# EasyEDA Pro project 3SE_24_Power_Rune.eprj, board 深大PCB参考 (continued)
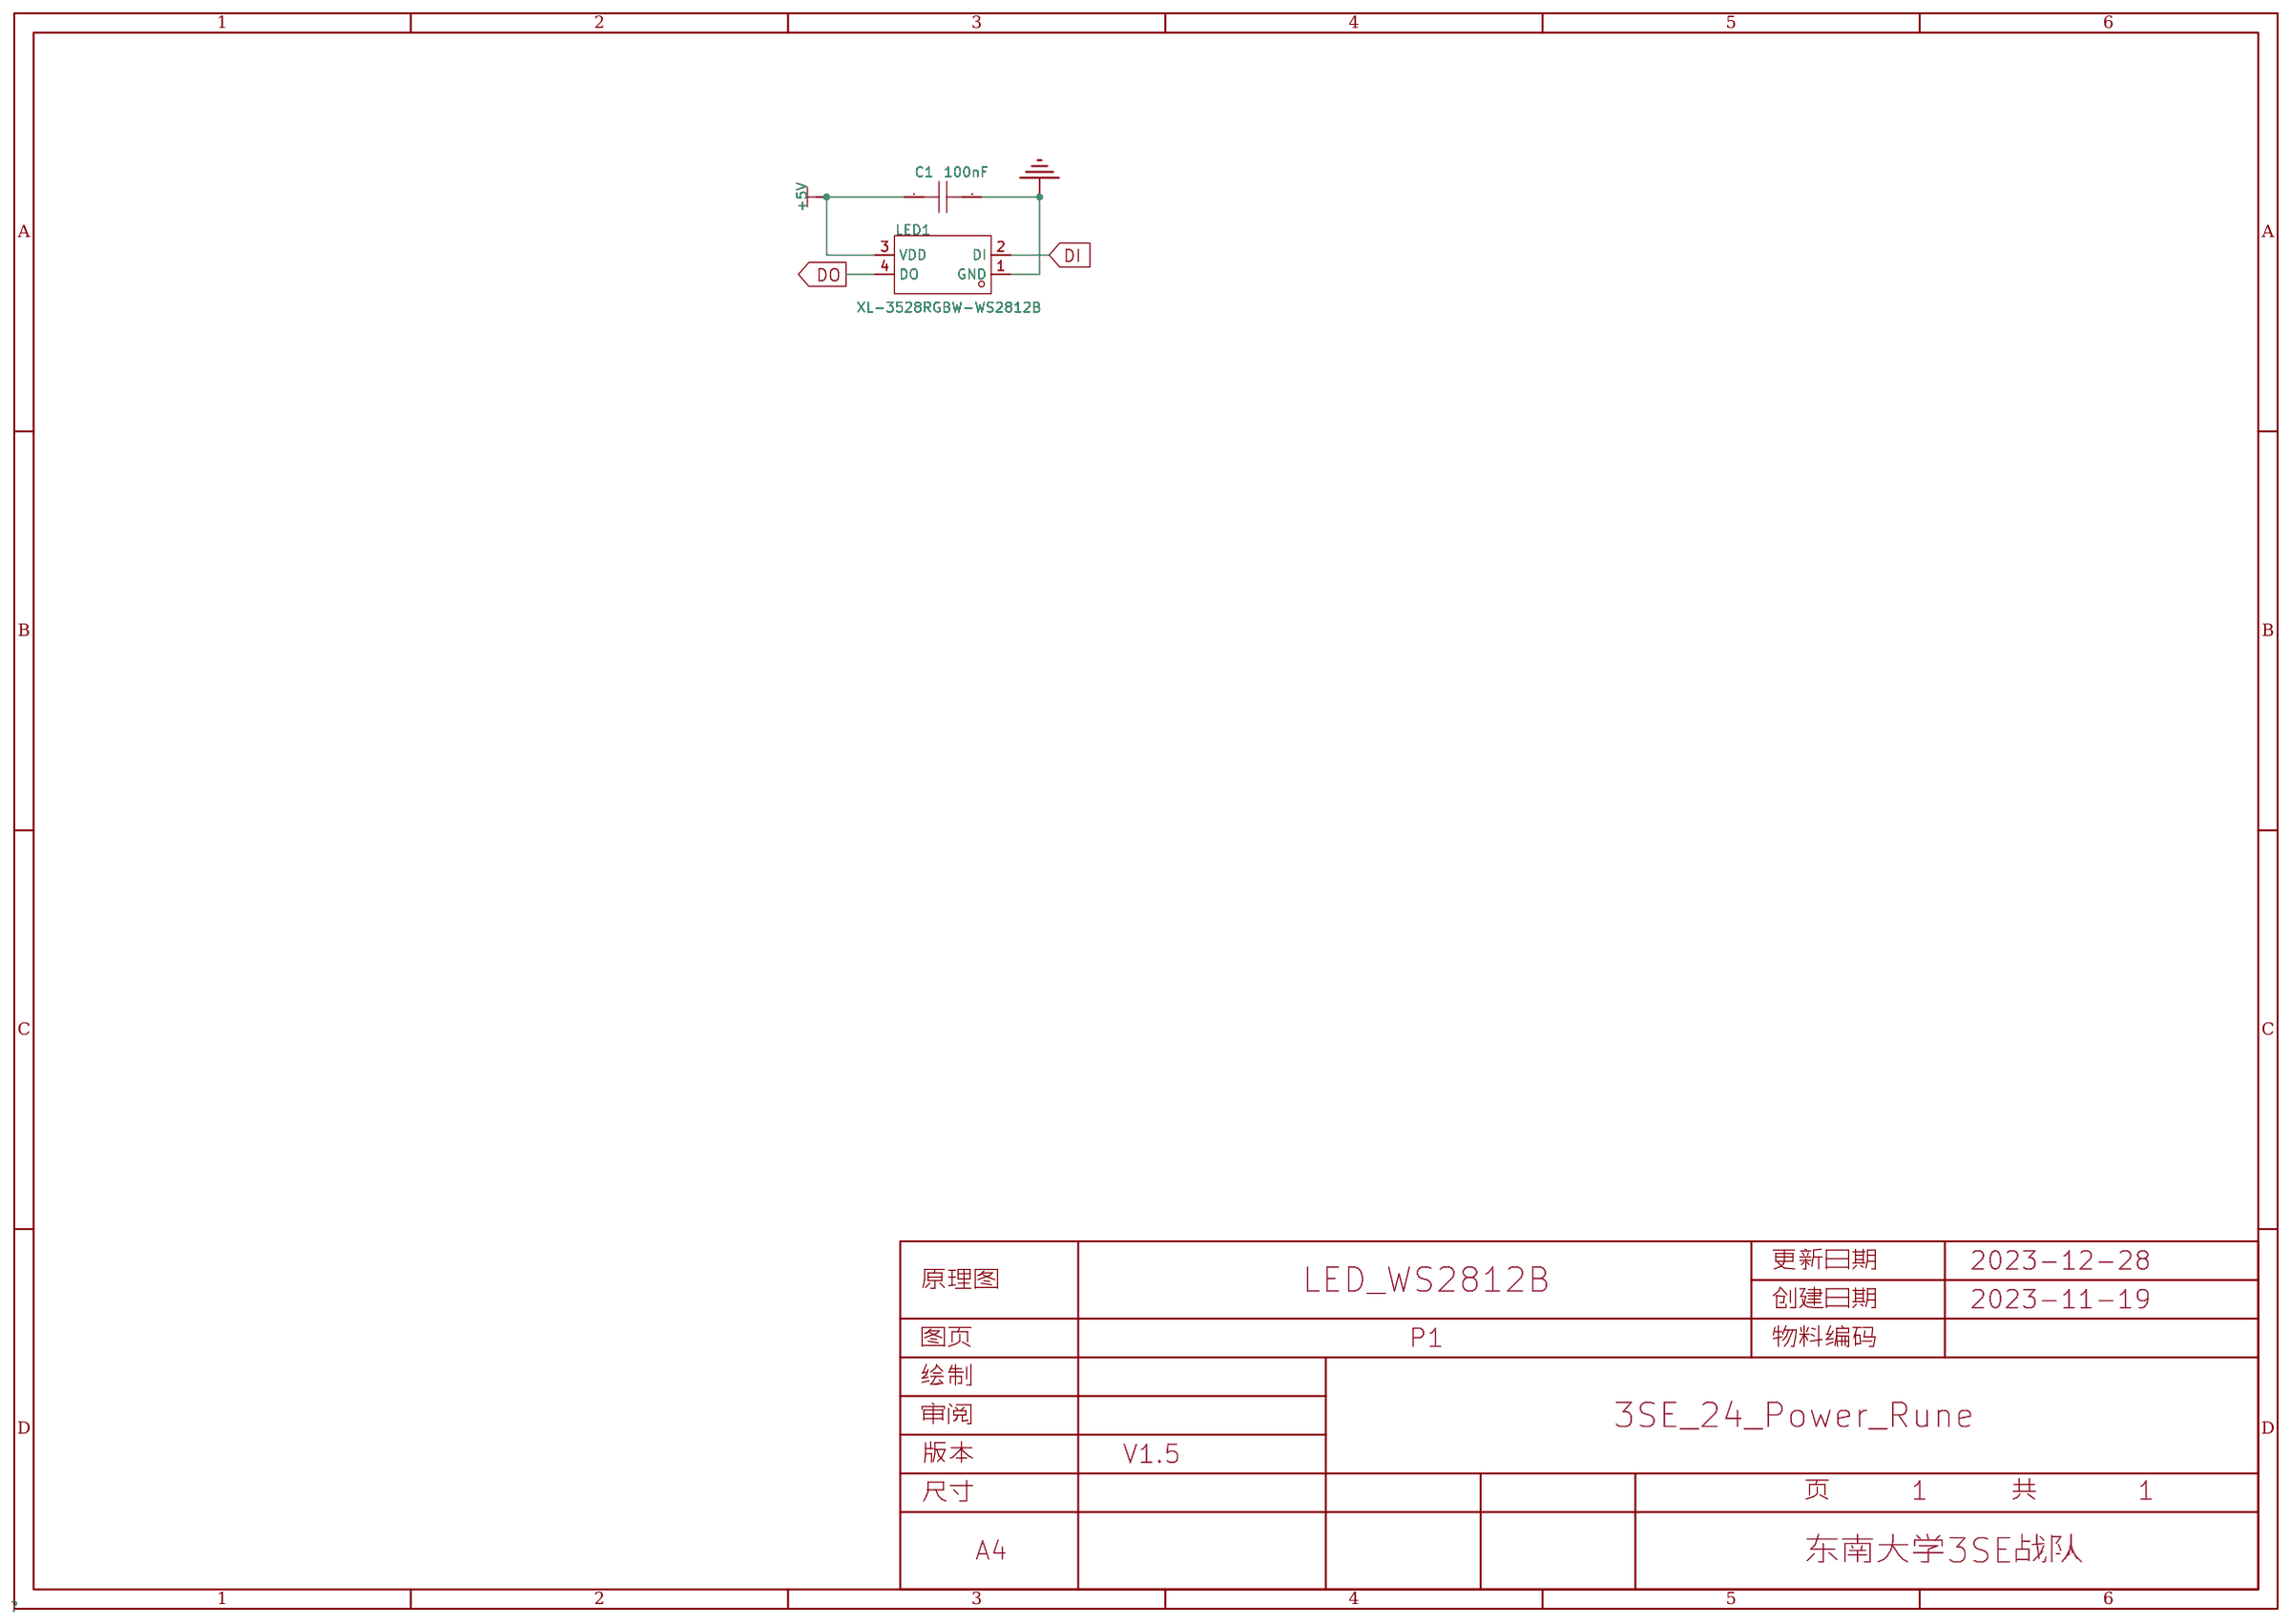
[diagram p0: schematic sheet]
## Routing (per net, layer and track width the routed paths; a pad name or vN(x,y) marks a point on that pad's centre or on a via; arc(x,y) is an arc through that point) (continued)
R_DET6: length 398.6
  Top Layer w0.381: 169.88,255.44 170.22,255.53 171.22,253.45 ; 120.22,177.37 120.31,177.04 123.34,177.65 arc(123.44,177.66) 123.53,177.64 124.01,177.5 124.21,177.13 arc(150.99,139.96) 195.97,131.27 196.48,131.27 arc(197.45,131.08) 198.28,130.53 199.48,129.32 199.48,130.04 arc(199.68,131.01) 200.23,131.83 200.77,132.38 arc(237.03,159.32) 245.43,203.7 arc(245.59,204.48) 246.03,205.14 248.08,207.18 246.64,207.18 arc(245.67,207.38) 244.84,207.93 244.36,208.41 arc(217.33,244.9) 172.7,253.23 171.56,253.24 arc(171.36,253.29) 171.22,253.45
  Bottom Layer w0.381: 169.88,255.44 170.47,254.86 arc(171.01,254.05) J8.1 ; J18.7 338.41,213.51 248.17,206.84 248.08,207.18
R_DET7: length 339.3
  Top Layer w0.381: 175.68,238.64 179.83,238.75 arc(210.55,230.98) 229.24,205.4 231.15,203.48 arc(231.98,202.93) 232.95,202.74 233.47,202.74 231.55,200.81 arc(231,199.99) 230.8,199.02 230.8,197.73 arc(223.68,166.97) 198.61,147.77 196.62,145.78 arc(196.1,145.03) 195.88,144.14 ; 173.18,240.96 173.52,241.05 175.37,238.78 arc(175.51,238.67) 175.68,238.64 ; 135.34,180.68 135.43,180.34 138.98,179.86 arc(139.16,179.79) 139.28,179.63 139.89,178.16 arc(159.84,152.55) 191.67,146.13 192.04,146.13 arc(193.01,145.93) 193.84,145.38 195.88,143.34
  Bottom Layer w0.381: 233.47,202.74 233.56,202.4 298.62,208.99 arc(298.63,208.99) 298.64,208.99 338.41,212.26 J18.8 ; 173.18,240.96 175.8,240.96 arc(175.86,240.95) J7.1
R_DET8: length 287.1
  Top Layer w0.381: 177.25,225.98 178.58,224.65 arc(179.4,224.09) 180.38,223.9 183.77,223.9 arc(201.97,220.09) 213.78,205.72 arc(213.95,204.85) 214.44,204.12 218.36,200.2 216.64,198.48 arc(216.09,197.66) 215.9,196.69 215.9,194.56 arc(211.85,176.53) 197.81,164.49 193.07,159.75 arc(192.52,158.92) 192.32,157.95 192.32,157.94 191.2,159.07 arc(190.37,159.62) 189.4,159.81 186.69,159.81 arc(173.77,162.38) 162.81,169.7 arc(158.26,175.17) 154.78,181.39 152.99,183.17 arc(151.77,183.98) .1
  Bottom Layer w0.381: 329.62,205.34 232.39,193.94 arc(232.29,193.94) 232.19,193.97 ; J18.9 338.41,211.01 332.7,210.58 arc(332.52,210.52) 332.39,210.38 329.91,205.54 arc(329.79,205.4) 329.62,205.34 ; J6.1 179.14,226.82 arc(178.17,226.63) 177.34,226.08 177.25,225.98 ; 232.19,193.97 218.45,199.86 218.36,200.2
R_DET9: length 236.6
  Top Layer w0.381: 163.91,193.25 164,192.91 183.38,169.89 SW5.1 184.05,170.07 192.52,177.22 arc(192.54,177.22) 192.55,177.24 206.79,191.22 SW6.1 206.61,191.9 185.46,214.64 SW3.1
  Bottom Layer w0.381: J18.10 338.41,209.76 334.75,209.69 arc(334.55,209.63) 334.42,209.48 331.18,203.12 arc(331.06,202.98) 330.9,202.92 225.7,186.29 206.79,191.22 SW6.1 ; SW3.1 185.56,214.1 arc(185.93,213.8) 186.35,213.57 arc(186.84,213.41) 187.36,213.36 J5.1
R_DET10: length 187.5
  Top Layer w0.381: 183.01,184.79 182.66,184.79 182.59,184.85 179.31,187.87 arc(179.22,187.98) 179.19,188.12 ; 179.19,188.12 178.71,195.58 arc(178.76,195.79) 178.92,195.94 185.96,199.26 SW1.1
  Bottom Layer w0.381: J4.1 188.75,197.88 arc(187.78,198.07) 186.95,198.62 SW1.1 ; 183.01,184.79 184.23,184.79 190.53,182.39 190.57,182.38 219.32,178.55 219.34,178.55 219.4,178.55 333.16,201.93 333.29,202.06 333.32,202.13 335.96,207.96 arc(336.07,208.11) 336.25,208.18 338.41,208.51 J18.11

## Copper pours and planes (outline as drawn; the poured copper is in the pictures)
GND on Top Layer: 14.99,253.11 27.94,351.92 134.37,381.51 234.82,381.63 340.61,349.38 355.35,247.78 345.44,237.74 346.33,155.32 346.33,154.94 363.35,149.48 369.95,29.72 221.36,0.13 147.7,0.13 0.13,33.15 7.24,146.94 20.83,150.75 21.34,240.54
GND on Bottom Layer: 161.54,281.31 164.72,282.19 164.08,284.86 165.1,285.12 165.48,283.59 167.13,282.83 167.89,282.96 168.7,279.86 162.35,278.21
GND on Bottom Layer: 338.2,207.77 341.5,207.77 341.5,207.01 338.2,207.01
GND on Bottom Layer: 150.88,324.36 154.05,325.25 153.42,327.91 154.43,328.17 154.81,326.64 156.46,325.88 157.23,326.01 158.03,322.91 151.68,321.26
GND on Bottom Layer: 190.63,211.2 189.74,214.38 187.07,213.74 186.82,214.76 188.34,215.14 189.1,216.79 188.98,217.55 192.08,218.36 193.73,212.01
GND on Bottom Layer: 24.48,231.9 24.48,235.3 28.03,235.32 28.03,237.86 29.03,237.86 29.03,236.42 30.27,235.31 31.33,235.31 31.33,231.9
GND on Bottom Layer: 169.04,250.83 172.21,251.71 171.58,254.38 172.59,254.64 172.97,253.11 174.62,252.35 175.39,252.48 176.2,249.38 169.85,247.73
GND on Bottom Layer: 182.5,224.66 181.61,227.84 178.94,227.2 178.69,228.22 180.21,228.6 180.98,230.25 180.85,231.01 183.95,231.82 185.6,225.47
GND on Bottom Layer: 158.24,296.04 161.42,296.93 160.78,299.59 161.8,299.85 162.18,298.32 163.83,297.56 164.59,297.69 165.4,294.59 159.05,292.94
GND on Bottom Layer: 31.33,157.02 31.33,153.63 27.78,153.61 27.78,151.07 26.78,151.07 26.78,152.5 25.54,153.62 24.48,153.62 24.48,157.02
GND on Bottom Layer: 178.18,238.76 177.29,241.94 174.62,241.3 174.37,242.32 175.89,242.7 176.66,244.35 176.53,245.11 179.63,245.92 181.28,239.57
GND on Bottom Layer: 27.94,195.96 31.33,195.96 31.36,192.41 33.9,192.41 33.9,191.4 32.46,191.4 31.35,190.16 31.35,189.1 27.94,189.1
GND on Bottom Layer: 193.93,195.07 190.54,195.07 190.51,198.62 187.97,198.62 187.97,199.63 189.41,199.63 190.52,200.87 190.52,201.93 193.93,201.93
GND on Bottom Layer: 341,223.52 343.79,223.52 343.79,205.11 341,205.11
GND on Bottom Layer: 154.32,309.87 157.5,310.76 156.86,313.43 157.88,313.68 158.26,312.16 159.91,311.39 160.67,311.52 161.48,308.42 155.13,306.77
GND on Bottom Layer: 165.35,265.56 168.53,266.45 167.89,269.11 168.91,269.37 169.29,267.84 170.94,267.08 171.7,267.21 172.51,264.11 166.16,262.46
GND on Bottom Layer: 338.2,218.95 341.12,218.95 341.12,218.31 338.2,218.31
VCC on Bottom Layer: 0,33.02 6.98,147.07 20.7,150.88 21.21,240.67 14.86,252.98 27.81,351.92 134.37,381.51 234.82,381.76 340.74,349.38 355.47,247.4 345.57,237.36 346.46,155.07 363.6,149.48 370.08,29.59 221.34,0 147.68,0

## Text on the board
Bottom Silkscreen Layer: 1 | G | 10 | DIN3 | DIN1 | DIN2
